# EasyEDA Pro project F4_Camera.eprj (continued)
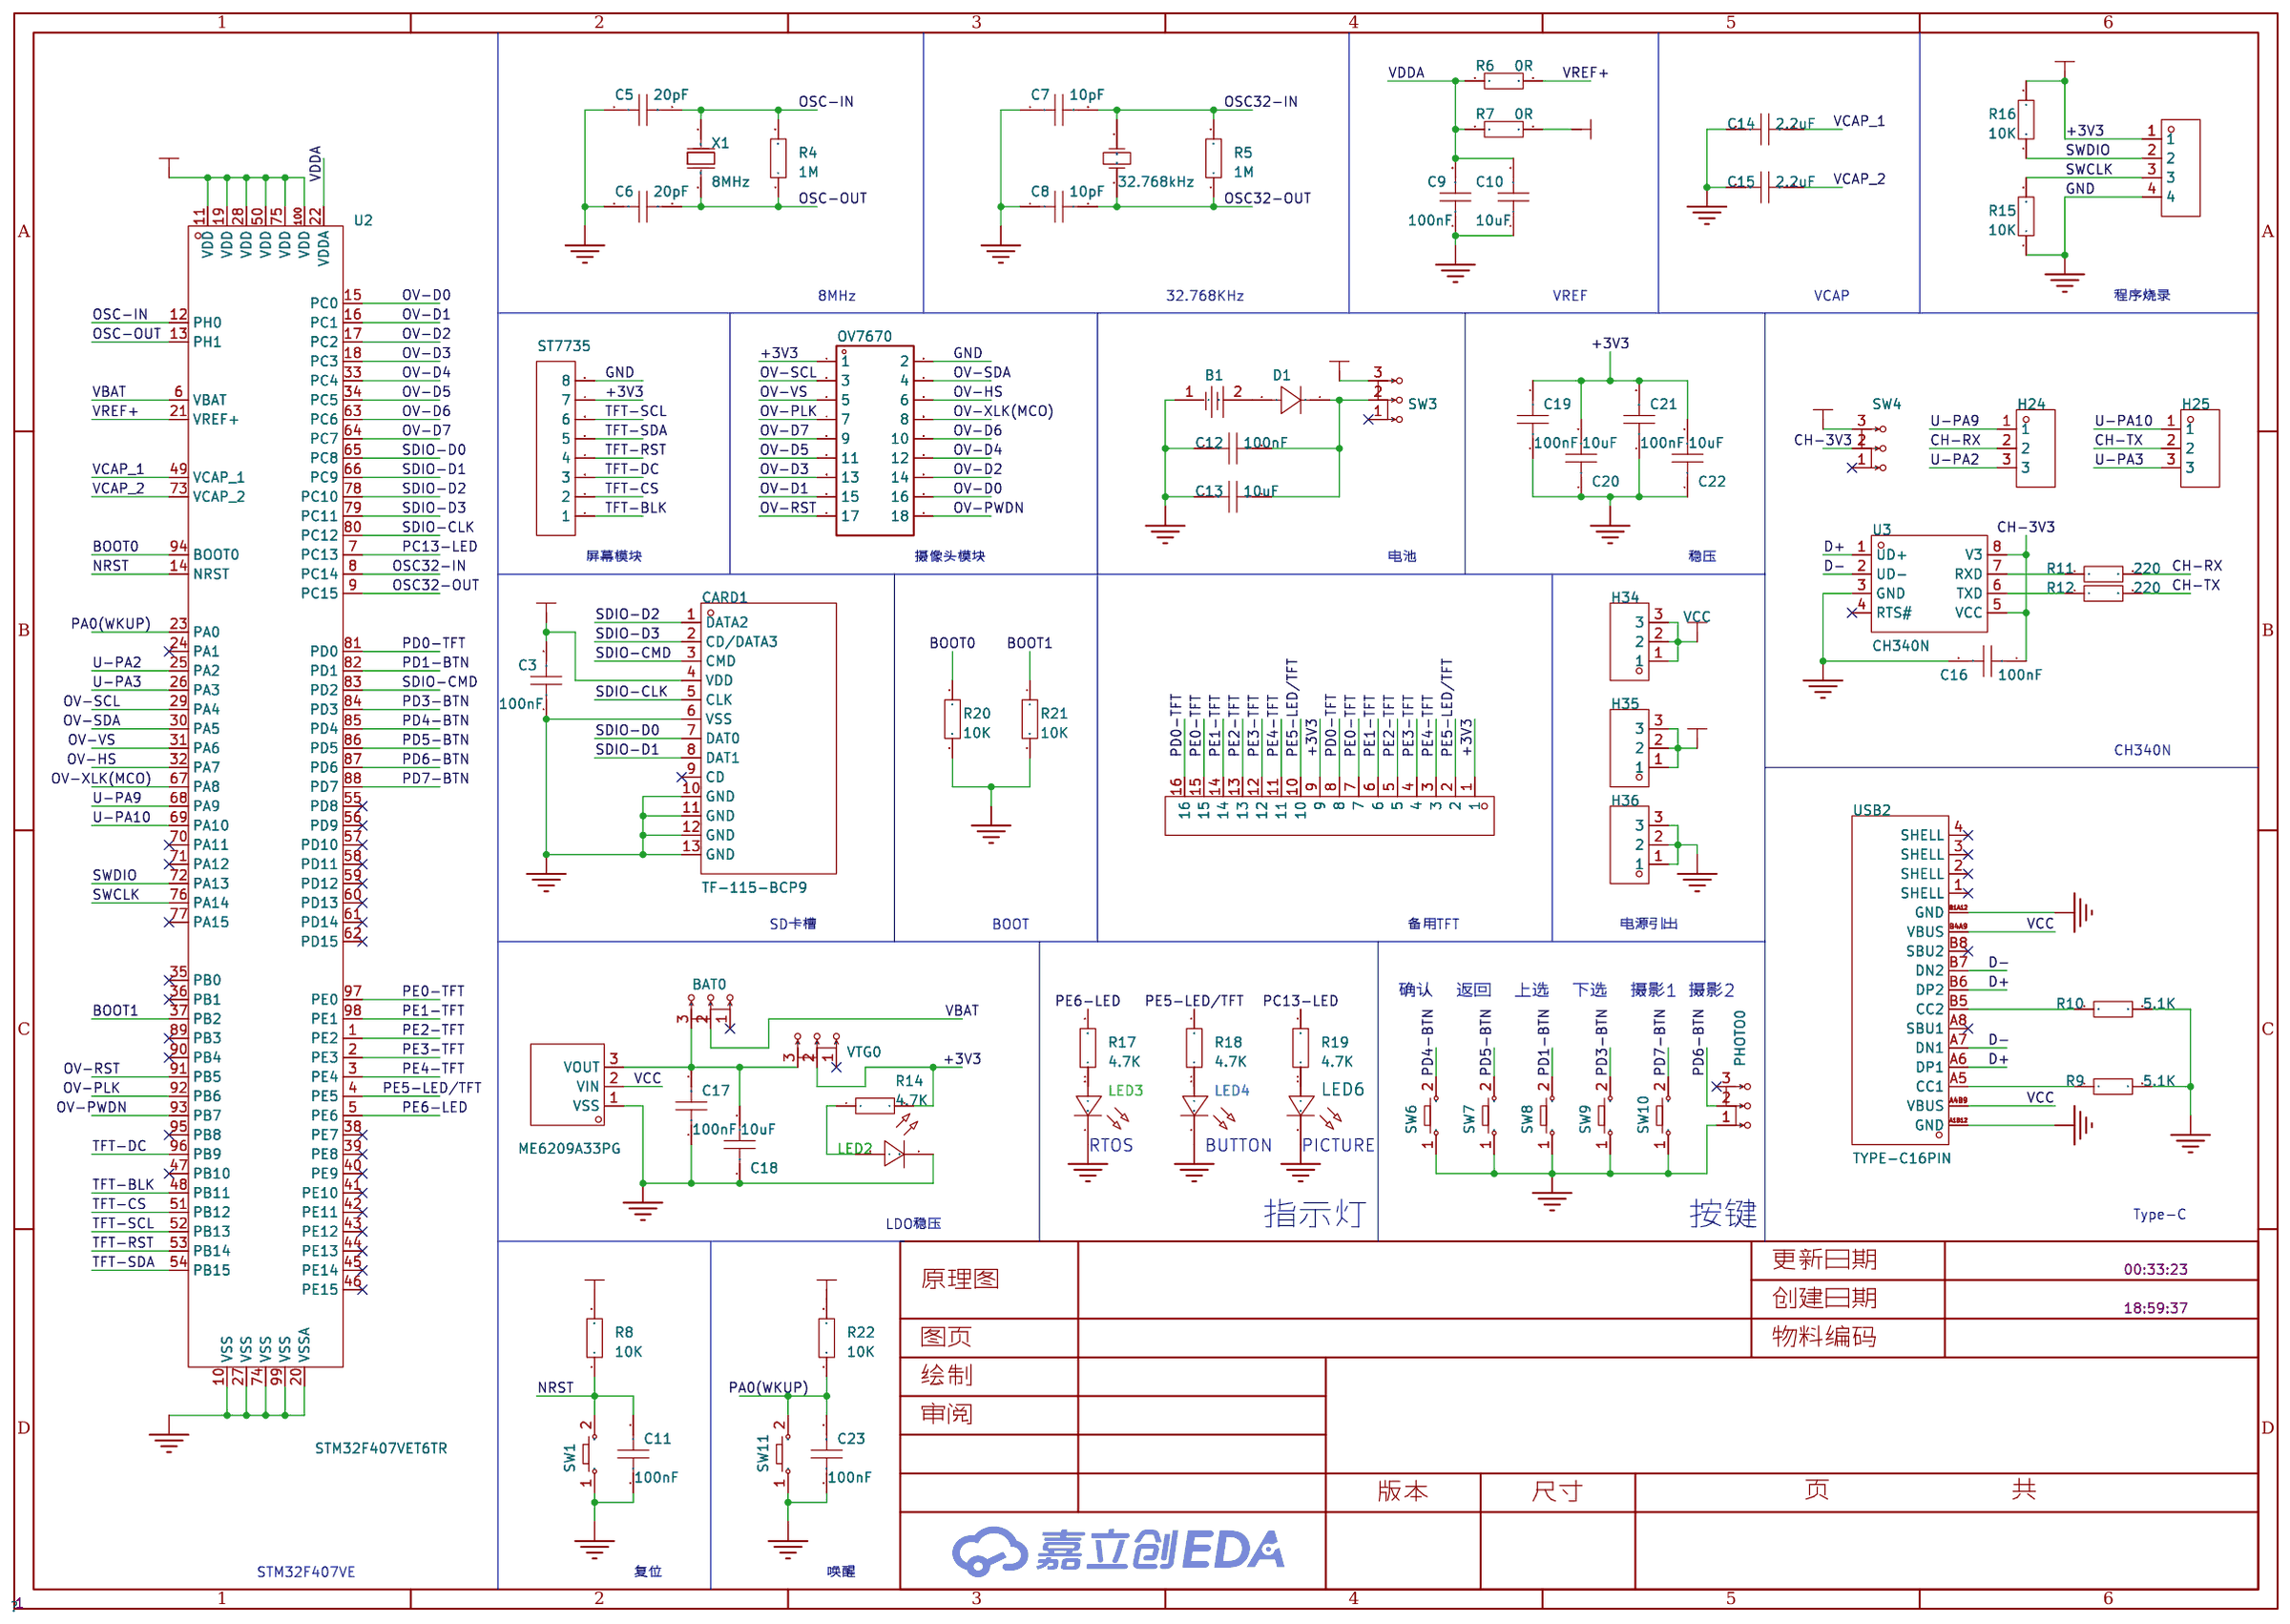
[diagram p0: schematic sheet]
## Placement (name value [footprint] x y rotation side)
B1  BS-02-A1AJ010  [BAT-TH_BS-02-A1AJ010]  63.63 31.34 90 bottom
BAT0  SS-12D01-G5  [SW-TH_SS-12D01-GX]  31.63 58.93 90 top
C3  100nF  [C0805]  16.76 17.22 90 top
C5  20pF  [C0805]  33.21 17.5 0 top
C6  20pF  [C0805]  40.02 17.5 180 top
C7  10pF  [C0805]  21.39 17.22 90 top
C8  10pF  [C0805]  28.65 17.22 90 top
C9  100nF  [C0805]  46.9 16.31 0 top
C10  10uF  [C0805]  46.9 13 0 top
C11  100nF  [C0805]  70.99 13.08 180 top
C12  100nF  [C0805]  68.58 45.66 180 top
C13  10uF  [C0805]  68.58 48.87 180 top
C14  2.2uF  [C0805]  47.03 40.49 90 top
C15  2.2uF  [C0805]  24.21 40.33 270 top
C16  100nF  [C0805]  3.41 50.38 90 top
C17  100nF  [C0805]  15.69 56.12 90 top
C18  10uF  [C0805]  18.95 56.12 90 top
C19  100nF  [C0805]  20.58 32.57 180 top
C20  10uF  [C0805]  15.4 36.12 180 top
C21  100nF  [C0805]  20.58 36.12 180 top
C22  10uF  [C0805]  15.4 32.57 180 top
C23  100nF  [C0805]  59.44 13.08 180 top
CARD1  TF-115-BCP9  [TF-SMD_TF-115-BCP9]  6.86 18.39 270 top
D1  -  [SMA_1N4007]  63.51 48.45 270 top
H24  -  [HDR-TH_3P-P2.54-V-M]  19.75 43.43 90 top
H25  -  [HDR-TH_3P-P2.54-V-M]  15.68 43.43 90 top
H34  -  [HDR-TH_3P-P2.54-V-M]  43.13 59.4 90 top
H35  -  [HDR-TH_3P-P2.54-V-M]  49.16 59.4 90 top
H36  -  [HDR-TH_3P-P2.54-V-M]  55.2 59.4 90 top
H37  -  [HDR-TH_4P-P2.54-V-M]  4.06 34.01 270 top
H38  -  [HDR-TH_16P-P2.54-V-F]  76.45 29.82 270 top
LED2  -  [LED_0805]  22.18 51.29 90 top
LED3  -  [LED_0805]  58.71 34.73 180 top
LED4  -  [LED_0805]  69.08 34.73 180 top
LED6  -  [LED_0805]  63.9 34.73 180 top
OV7670  -  [HDR-TH_18P-P2.54-V-F-R2-C9-S2.54-1]  37.08 49.25 0 bottom
PHOTO0  SS-12D01-G5  [SW-TH_SS-12D01-GX]  63.58 58.59 90 top
R4  1M  [R0805]  36.61 20.78 180 top
R5  1M  [R0805]  25.02 21.19 180 top
R6  0R  [R0805]  46.78 22.55 180 top
R7  0R  [R0805]  46.77 19.5 180 top
R8  10K  [R0805]  70.85 17.09 0 top
R9  5.1K  [R0805]  11.91 60.39 90 top
R10  5.1K  [R0805]  11.91 56.14 270 top
R11  220  [R0805]  18.97 51.13 270 top
R12  220  [R0805]  15.71 51.13 270 top
R14  4.7K  [R0805]  22.11 56.07 90 top
R15  10K  [R0805]  9.57 30.92 90 top
R16  10K  [R0805]  9.57 37.11 90 top
R17  4.7K  [R0805]  58.59 37.9 0 top
R18  4.7K  [R0805]  68.96 37.9 0 top
R19  4.7K  [R0805]  63.78 37.9 0 top
R20  10K  [R0805]  20.72 29.12 180 top
R21  10K  [R0805]  47.04 34.55 90 top
R22  10K  [R0805]  59.3 17.09 0 top
ST7735  -  [HDR-TH_8P-P2.54-V-F-1]  50.8 32.23 90 top
SW1  -  [Key_SMD_3x4x2]  66.41 14.98 90 top
SW3  SS-12D01-G5  [SW-TH_SS-12D01-GX]  37.47 58.93 90 top
SW4  SS-12D01-G5  [SW-TH_SS-12D01-GX]  7.22 43.47 0 top
SW6  -  [Key_SMD_3x4x2]  59.44 30.2 0 top
SW7  -  [Key_SMD_3x4x2]  59.44 24.61 0 top
SW8  -  [Key_SMD_3x4x2]  68.33 30.2 0 top
SW9  -  [Key_SMD_3x4x2]  68.33 24.61 0 top
SW10  -  [Key_SMD_3x4x2]  69.17 60 90 top
SW11  -  [Key_SMD_3x4x2]  54.6 14.98 90 top
U2  STM32F407VET6TR  [LQFP-100_L14.0-W14.0-P0.50-LS16.0-BL]  34.93 34.01 0 top
U3  CH340N  [SOP-8_L4.9-W3.9-P1.27-LS6.0-BL]  9.27 50.39 270 top
U4  ME6209A33PG  [SOT-89-3_L4.5-W2.5-P1.50-LS4.2-BR]  17.37 61.01 270 top
USB2  TYPE-C16PIN  [USB-C-SMD_TYPE-C16PIN]  4.19 58.9 270 top
VTG0  SS-12D01-G5  [SW-TH_SS-12D01-GX]  25.79 58.93 90 top
X1  8MHz  [CRYSTAL-SMD_L11.5-W4.8-LS12.7]  36.62 12.3 0 top
X3  32.768kHz  [OSC-TH_BD3.1-P0.8-D0.3]  25.15 18.39 90 top

## Footprints (pads in the part's own frame, mm; a bottom-side part is the same pattern mirrored in y, then rotated)
BAT-TH_BS-02-A1AJ010
  round 1.8 hole 1.2: 1(-10,0) 2(10,0)
C0805
  rect 1.41x1.35 smd: 1(-1,0) 2(1,0)
CRYSTAL-SMD_L11.5-W4.8-LS12.7
  rect 5.5x2 smd: 1(-4.45,0) 2(4.45,0)
HDR-TH_3P-P2.54-V-M
  rect 1.7x1.7 hole 1.1: 1(-2.54,0)
  round 1.7 hole 1.1: 2(0,0) 3(2.54,0)
HDR-TH_4P-P2.54-V-M
  rect 1.7x1.7 hole 1.1: 1(-3.81,0)
  round 1.7 hole 1.1: 2(-1.27,0) 3(1.27,0) 4(3.81,0)
HDR-TH_8P-P2.54-V-F-1
  rect 1.8x1.8 hole 1.2: 1(-8.89,0)
  round 1.8 hole 1.2: 2(-6.35,0) 3(-3.81,0) 4(-1.27,0) 5(1.27,0) 6(3.81,0) 7(6.35,0) 8(8.89,0)
HDR-TH_16P-P2.54-V-F
  rect 1.6x1.6 hole 1: 1(-19.05,0)
  round 1.6 hole 1: 2(-16.51,0) 3(-13.97,0) 4(-11.43,0) 5(-8.89,0) 6(-6.35,0) 7(-3.81,0) 8(-1.27,0) 9(1.27,0) 10(3.81,0) 11(6.35,0) 12(8.89,0) 13(11.43,0) 14(13.97,0) 15(16.51,0) 16(19.05,0)
HDR-TH_18P-P2.54-V-F-R2-C9-S2.54-1
  rect 1.7x1.7 hole 1.1: 1(-10.16,-1.27)
  round 1.7 hole 1.1: 2(-10.16,1.27) 3(-7.62,-1.27) 4(-7.62,1.27) 5(-5.08,-1.27) 6(-5.08,1.27) 7(-2.54,-1.27) 8(-2.54,1.27) 9(0,-1.27) 10(0,1.27) 11(2.54,-1.27) 12(2.54,1.27) 13(5.08,-1.27) 14(5.08,1.27) 15(7.62,-1.27) 16(7.62,1.27) 17(10.16,-1.27) 18(10.16,1.27)
Key_SMD_3x4x2
  rect 1.53x1.36 smd: 1(-2.035,0) 2(2.035,0)
LED_0805
  rect 1x1.25 smd: 1(-1.15,0.005) 2(1.05,0.005)
LQFP-100_L14.0-W14.0-P0.50-LS16.0-BL
  oval 0.3x1.6 smd: 1(-6,-7.55) 2(-5.5,-7.55) 3(-5,-7.55) 4(-4.5,-7.55) 5(-4,-7.55) 6(-3.5,-7.55) 7(-3,-7.55) 8(-2.5,-7.55) 9(-2,-7.55) 10(-1.5,-7.55) 11(-1,-7.55) 12(-0.5,-7.55) 13(0,-7.55) 14(0.5,-7.55) 15(1,-7.55) 16(1.5,-7.55) 17(2,-7.55) 18(2.5,-7.55) 19(3,-7.55) 20(3.5,-7.55) 21(4,-7.55) 22(4.5,-7.55) 23(5,-7.55) 24(5.5,-7.55) 25(6,-7.55) 51(6,7.55) 52(5.5,7.55) 53(5,7.55) 54(4.5,7.55) 55(4,7.55) 56(3.5,7.55) 57(3,7.55) 58(2.5,7.55) 59(2,7.55) 60(1.5,7.55) 61(1,7.55) 62(0.5,7.55) 63(0,7.55) 64(-0.5,7.55) 65(-1,7.55) 66(-1.5,7.55) 67(-2,7.55) 68(-2.5,7.55) 69(-3,7.55) 70(-3.5,7.55) 71(-4,7.55) 72(-4.5,7.55) 73(-5,7.55) 74(-5.5,7.55) 75(-6,7.55)
  oval 1.6x0.3 smd: 26(7.55,-6) 27(7.55,-5.5) 28(7.55,-5) 29(7.55,-4.5) 30(7.55,-4) 31(7.55,-3.5) 32(7.55,-3) 33(7.55,-2.5) 34(7.55,-2) 35(7.55,-1.5) 36(7.55,-1) 37(7.55,-0.5) 38(7.55,0) 39(7.55,0.5) 40(7.55,1) 41(7.55,1.5) 42(7.55,2) 43(7.55,2.5) 44(7.55,3) 45(7.55,3.5) 46(7.55,4) 47(7.55,4.5) 48(7.55,5) 49(7.55,5.5) 50(7.55,6) 76(-7.55,6) 77(-7.55,5.5) 78(-7.55,5) 79(-7.55,4.5) 80(-7.55,4) 81(-7.55,3.5) 82(-7.55,3) 83(-7.55,2.5) 84(-7.55,2) 85(-7.55,1.5) 86(-7.55,1) 87(-7.55,0.5) 88(-7.55,0) 89(-7.55,-0.5) 90(-7.55,-1) 91(-7.55,-1.5) 92(-7.55,-2) 93(-7.55,-2.5) 94(-7.55,-3) 95(-7.55,-3.5) 96(-7.55,-4) 97(-7.55,-4.5) 98(-7.55,-5) 99(-7.55,-5.5) 100(-7.55,-6)
OSC-TH_BD3.1-P0.8-D0.3
  round 1.2 hole 0.8: 1(0,0.8) 2(0,-0.8)
R0805
  rect 1.133x1.377 smd: 1(-1,0) 2(1,0)
SMA_1N4007
  rect 2.046x1.62 smd: 1(-2.566,0) 2(2.566,0)
SOP-8_L4.9-W3.9-P1.27-LS6.0-BL
  oval 0.63x1.865 smd: 1(-1.905,-2.683) 2(-0.635,-2.683) 3(0.635,-2.683) 4(1.905,-2.683) 5(1.905,2.683) 6(0.635,2.683) 7(-0.635,2.683) 8(-1.905,2.683)
SOT-89-3_L4.5-W2.5-P1.50-LS4.2-BR
  rect 1.575x0.672 smd: 1(1.356,-1.5) 3(1.356,1.5)
  custom 0x0 smd: 2(-1.356,0)
SW-TH_SS-12D01-GX
  round 1.524 hole 0.914: 1(-2.5,0) 2(0,0) 3(2.5,0)
TF-SMD_TF-115-BCP9
  rect 0.7x1.6 smd: 1(2.25,5.3) 2(1.15,5.3) 3(0.05,5.3) 4(-1.05,5.3) 5(-2.15,5.3) 6(-3.25,5.3) 7(-4.35,5.3) 8(-5.45,5.3) 9(-6.55,5.3)
  rect 1.2x1.5 smd: 10(-7.75,4.3)
  rect 1.2x2.2 smd: 11(-7.75,-5.3) 13(7.75,-5.3)
  rect 1.6x1.5 smd: 12(6.85,4.3)
USB-C-SMD_TYPE-C16PIN
  oval 1x2.1 hole 0.6x1.7: 1(-4.32,1.788) 2(4.32,1.788)
  oval 1x1.8 hole 0.6x1.4: 3(-4.32,-2.362) 4(4.32,-2.362)
  rect 0.6x1.15 smd: A1B12(-3.2,2.362) A4B9(-2.4,2.362) B1A12(3.2,2.362) B4A9(2.4,2.362)
  rect 0.3x1.15 smd: A5(-1.25,2.362) A6(-0.25,2.362) A7(0.25,2.362) A8(1.25,2.362) B5(1.75,2.362) B6(0.75,2.362) B7(-0.75,2.362) B8(-1.75,2.362)

## Nets
As in the schematic.

Pads without a net: BAT0 1; CARD1 9; PHOTO0 3; SW3 1; SW4 1; U2 24 35 36 38 39 40 41 42 43 44 45 46 47 55 56 57 58 59 60 61 62 70 71 77 89 90 95; U3 4; USB2 1 2 3 4 A8 B8; VTG0 1

## Via types
v1: diameter 4.572, hole 3.556, Top Layer to Bottom Layer, 3 vias
v2: diameter 0.61, hole 0.305, Top Layer to Bottom Layer, 221 vias

## Routing (per net, layer and track width the routed paths; a pad name or vN(x,y) marks a point on that pad's centre or on a via; arc(x,y) is an arc through that point)
+3V3: length 382.9
  Top Layer w0.254: U2.11 33.93,23.36 v2(33.66,23.09) ; U2.50 44.99,40.01 v2(45.21,40.23) ; H38.9 v2(72.01,28.55)
  Top Layer w0.305: R16.2 9.72,38.26 SW4.3 ; v2(26.23,26.33) 27.38,27.48 U2.100 ; 61.95,11.28 73.53,11.28 74.04,11.79 74.04,16.61 73.53,17.12 71.88,17.12 R8.2 ; 61.95,11.28 61.98,11.3 61.98,16.61 61.5,17.09 R22.2 ; 61.95,11.28 50.8,11.28 50.16,11.91 v2(50.16,15.22) ; 19.64,37.69 19.58,37.64 C21.2 ; R7.2 45.73,19.53 v2(41.66,19.53) ; v2(37.08,23.98) 37.59,23.98 37.93,24.31 U2.19 37.93,28.38 38.56,29.01 U2.28 ; v2(18.03,33.63) 18.03,32.74 18.29,32.49 19.5,32.49 C19.2
  Top Layer w0.355: C19.2 19.56,32.6 19.56,36.1 C21.2 ; OV7670.1 26.8,50.39 v2(24.26,50.39) 24.26,58.89 24.27,58.9 ; 24.27,58.9 25.77,58.9 VTG0.2 ; 24.27,58.9 22.73,58.9 22.11,58.28 R14.2 ; 14.35,19.44 16.48,19.44 16.76,19.15 C3.2 ; 14.35,19.44 14.35,28.17 ; 14.35,19.44 CARD1.4 ; U2.75 28.09,42.39 v2(25.65,42.39) 25.65,38.58 24.76,37.69 14.73,37.69 14.4,37.37 C20.2 C22.2 14.35,32.52 14.35,28.17 ; 14.35,28.17 2.54,28.17 1.78,28.93 1.78,37.06 2.54,37.82 H37.1 4.35,38.11 R16.2
  Top Layer w0.508: H35.1 H35.2 H35.3
  Bottom Layer w0.305: v2(33.66,23.09) 36.19,23.09 v2(37.08,23.98) 40.51,23.98 41.66,22.84 v2(41.66,19.53) 41.66,17.25 43.69,15.22 v2(50.16,15.22) ; 72.01,48.88 72.01,62.46 71.12,63.35 50.57,63.35 H35.3 ; 72.01,48.88 v2(72.01,28.55) ; 72.01,48.88 72.02,48.87 H38.1 ; ST7735.7 53.72,38.58 54.48,39.35 54.48,54.33 53.72,55.09 49.78,55.09 49.15,55.73 49.15,56.85 ; v2(45.21,40.23) 45.85,40.23 46.23,39.85 46.23,33.76 45.72,33.25 18.41,33.25 v2(18.03,33.63)
  Bottom Layer w0.355: v2(14.36,26.34) 14.41,26.39 26.16,26.39 v2(26.23,26.33) 27.31,27.41 31.88,27.41 33.66,25.63 v2(33.66,23.09) ; v2(25.65,42.39) 24.26,43.79 v2(24.26,50.39) ; H35.1 49.15,56.85 47.6,56.85 45.34,54.59 28.83,54.59 28.07,55.35 28.07,58.27 27.41,58.93 VTG0.2
GND: length 29.6
  Top Layer w0.254: U2.10 33.43,27.94 v2(32.44,28.93) 31.37,28.93 30.48,28.04 29.08,28.04 28.61,28.51 U2.99 ; U2.74 29.43,40.53 29.97,39.98 30.86,39.98 33.91,36.93 33.91,34.58 v2(34.54,33.95) ; U2.20 38.43,27.99 38.95,28.51 U2.27
  Top Layer w0.508: H36.3 H36.2 H36.1
  vias: v2(3.68,21.06) v2(3.68,18.84) v2(3.68,16.61) v2(4.06,40.36) v2(4.7,46.2) v2(4.95,57) v2(6.22,40.36) v2(8.38,40.36) v2(9.8,46.2) v2(10.54,40.36) v2(10.67,33.25) v2(12.83,27.15) v2(13.46,34.27) v2(13.59,7.72) v2(13.59,6.45) v2(13.59,5.18) v2(13.84,40.87) v2(16.38,34.27) v2(17.65,29.82) v2(17.78,40.87) v2(21.08,59.92) v2(21.34,34.14) v2(21.97,59.92) v2(22.61,47.86) v2(22.61,46.53) v2(22.86,59.92) v2(22.86,19.66) v2(23.65,16.39) v2(23.65,14.39) v2(23.65,12.39) v2(23.65,10.39) v2(23.65,8.39) v2(25.15,8.39) v2(26.54,41.63) v2(26.65,16.39) v2(26.65,14.39) v2(26.65,12.39) v2(26.65,10.39) v2(26.65,8.39) v2(30.1,34.27) v2(30.92,14.7) v2(30.92,9.9) v2(31.88,22.07) v2(32.3,15.59) v2(33.15,19.41) v2(33.2,9.9) v2(33.66,43.54) v2(34.54,59.92) v2(34.54,58.84) v2(34.54,57.76) v2(35.48,9.9) v2(37.76,9.9) v2(38.48,46.08) v2(40,19.53) v2(40.04,9.9) v2(40.64,59.92) v2(40.64,58.84) v2(40.64,57.76) v2(40.96,15.59) v2(41.91,42.78) v2(42.32,14.7) v2(42.32,9.9) v2(42.54,23.22) v2(43.31,26.27) v2(44.2,38.08) v2(45.72,25.76) v2(45.85,10.01) v2(46.23,59.92) v2(46.23,58.83) v2(46.23,57.75) v2(46.86,25.76) v2(47.18,10.01) v2(48.01,25.76) v2(48.51,10.01) v2(50.8,20.55) v2(51.05,45.95) v2(52.37,20.55) v2(53.59,44.05) v2(53.95,20.55) v2(56.26,51.67) v2(56.26,50.01) v2(56.26,48.36) v2(56.26,46.71) v2(60.32,49.25) v2(60.32,47.35) v2(60.32,45.44) v2(64.01,30.43) v2(64.01,28.84) v2(64.01,27.24) v2(68.58,43.28) v2(68.58,42.01) v2(69.22,55.35) v2(69.22,53.63) v2(69.22,51.92) v2(69.98,42.01) v2(76.45,55.35) v2(76.45,53.63) v2(76.45,51.92)
VBAT: length 77.1
  Top Layer w0.305: v2(31.88,28.3) 31.43,27.84 U2.6 ; v2(12.83,29.06) 12.76,29.12 12.76,44.87 v2(12.7,44.93)
  Bottom Layer w0.305: v2(12.83,29.06) 13.72,28.17 31.75,28.17 v2(31.88,28.3) ; v2(12.7,44.93) 12.7,61.83 13.72,62.84 28.96,62.84 29.72,62.08 29.72,59.16 30.07,58.81 31.51,58.81 BAT0.2
VCC: length 56.1
  Top Layer w0.508: USB2.B4A9 8.88,56.5 v2(9.4,55.98) ; 37.59,63.48 37.47,63.36 SW3.3 ; 37.59,63.48 20.7,63.48 19.59,62.37 17.37,62.37 16.64,63.09 v2(9.46,63.09) 7.67,61.3 USB2.A4B9 ; 37.59,63.48 41.6,63.48 H34.3 H34.2 H34.1
  Bottom Layer w0.508: v2(9.46,63.09) 9.4,63.03 v2(9.4,55.98)
VDDA: length 21.3
  Top Layer w0.254: U2.22 39.43,24.56 40.13,23.85 47.5,23.85 47.75,23.6 47.75,22.58 R6.1 47.78,19.52 R7.1 47.77,16.45 C9.2 C10.2
(no net):
  vias: v1(3.5,3.5) v1(81.5,61.5) v1(81.5,3.5)
BOOT0: length 11.4
  Top Layer w0.254: v2(29.84,30.71) 29.54,31.01 U2.94 ; R20.1 22.79,29.12 v2(23.5,29.82)
  Bottom Layer w0.254: v2(23.5,29.82) 24.38,30.71 v2(29.84,30.71)
BOOT1: length 4.3
  Top Layer w0.254: 46.78,33.55 46.75,33.51 U2.37
CH-3V3: length 21.2
  Top Layer w0.254: U3.8 10.92,52.3 10.54,51.92 10.54,48.87 10.92,48.49 U3.5 11.95,47.87 11.3,47.22 7.22,47.22 ; 7.22,47.22 7.22,47.22 SW4.2 ; 7.22,47.22 3.94,47.22 3.43,47.73 3.43,49.37 C16.1
CH-RX: length 8.3
  Top Layer w0.254: H24.2 19.72,43.41 18.54,43.41 18.29,43.66 18.29,48.49 18.97,49.17 R11.2
CH-TX: length 8.7
  Top Layer w0.254: H25.2 15.66,43.41 14.48,43.41 14.22,43.66 14.22,48.24 15.71,49.72 R12.2
D+: length 13
  Top Layer w0.254: USB2.A6 7.5,59.15 7.75,58.9 7.75,58.4 7.49,58.14 6.57,58.14 USB2.B6 6.54,58.14 4.57,58.14 4.06,57.63 4.06,54.2 4.83,53.44 6.1,53.44 6.6,52.94 6.6,52.32 U3.1
D-: length 15.1
  Top Layer w0.254: 5.38,59.67 6.54,59.67 USB2.B7 ; 5.38,59.67 5.38,58.86 5.59,58.65 6.55,58.65 USB2.A7 ; 5.38,59.67 4.7,59.67 3.56,58.52 3.56,53.7 4.88,52.37 4.88,51.36 5.21,51.03 U3.2
NRST: length 50.4
  Top Layer w0.254: v2(42.54,21.31) 39.62,21.31 37.59,23.34 36.19,23.34 35.43,24.11 U2.14 ; v2(51.56,16.99) 51.56,18.52 52.2,19.15 65.79,19.15 66.42,18.52 66.42,17.03 SW1.2 69.78,17.02 R8.1 69.85,13.21 C11.2
  Bottom Layer w0.254: v2(51.56,16.99) 50.67,16.11 43.94,16.11 42.54,17.5 v2(42.54,21.31)
OSC32-IN: length 19
  Top Layer w0.254: U2.8 32.43,23.89 31.75,23.22 24.51,23.22 24.02,22.72 R5.2 24.02,18.72 X3.1 21.57,18.39 C7.2
OSC32-OUT: length 19
  Top Layer w0.254: U2.9 32.93,20.96 32.51,20.55 31.37,20.55 30.73,21.19 29.72,21.19 29.08,20.55 28.07,20.55 27.43,21.19 R5.1 26.02,18.46 X3.2 28.48,18.39 C8.2
OSC-IN: length 18.4
  Top Layer w0.254: X1.1 34.21,14.34 C5.2 34.34,17.38 35.31,17.38 35.61,17.68 R4.2 35.45,20.62 34.16,20.62 33.91,20.88 33.91,22.2 34.43,22.72 U2.12
OSC-OUT: length 18.4
  Top Layer w0.254: 38.99,17.47 38.99,14.38 X1.2 ; 38.99,17.47 C6.2 ; 38.99,17.47 38.89,17.38 37.85,17.38 37.61,17.61 R4.1 37.59,20.8 37.59,22.2 36.96,22.84 35.55,22.84 34.93,23.46 U2.13
OV-D0: length 37.9
  Top Layer w0.254: U2.15 35.93,27.88 v2(34.8,29.01)
  Bottom Layer w0.254: v2(34.8,29.01) 35.38,28.42 46.48,28.42 48.13,30.08 48.13,43.03 47.62,43.54 45.34,43.54 44.7,44.17 OV7670.16
OV-D1: length 54.8
  Top Layer w0.254: v2(50.29,52.43) 44.96,52.43 44.7,52.17 OV7670.15 ; v2(33.27,29.49) 33.38,29.59 35.22,29.59 36.43,28.38 U2.16
  Bottom Layer w0.254: v2(33.27,29.49) 33.27,28.3 34.16,27.41 47.37,27.41 49.15,29.19 49.15,43.79 50.29,44.93 v2(50.29,52.43)
OV-D2: length 40.2
  Top Layer w0.254: U2.17 36.93,28.76 v2(35.31,30.38)
  Bottom Layer w0.254: v2(35.31,30.38) 35.31,29.69 36.07,28.93 46.23,28.93 47.62,30.33 47.62,42.21 46.93,42.9 43.81,42.9 42.16,44.55 OV7670.14
OV-D3: length 57.7
  Top Layer w0.254: U2.18 37.43,28.97 36.45,29.95 36.45,30.46 35.94,30.96 34.62,30.96 v2(34.04,30.38)
  Bottom Layer w0.254: OV7670.13 42.16,52.94 42.54,53.32 47.88,53.32 49.4,51.79 49.4,44.81 48.64,44.05 48.64,29.57 46.99,27.92 34.54,27.92 34.04,28.42 v2(34.04,30.38)
OV-D4: length 19
  Top Layer w0.254: U2.33 40.22,31.51 39.65,32.08 v2(39.65,37.98)
  Bottom Layer w0.254: v2(39.65,37.98) 39.62,38.01 OV7670.12
OV-D5: length 52.8
  Top Layer w0.254: v2(53.34,53.95) 53.34,45.06 52.2,43.92 40.64,43.92 v2(40.26,43.54) ; U2.34 40.86,32.01 40.26,32.61 v2(40.26,38.49)
  Bottom Layer w0.254: v2(40.26,38.49) v2(40.26,43.54) ; v2(53.34,53.95) 40.13,53.95 39.62,53.44 OV7670.11
OV-D6: length 8
  Top Layer w0.254: U2.63 34.93,44.93 35.94,45.95 v2(37.08,45.95)
  Bottom Layer w0.254: v2(37.08,45.95) OV7670.10
OV-D7: length 43.2
  Top Layer w0.254: OV7670.9 37.08,52.55 37.59,53.06 50.67,53.06 51.18,52.55 51.18,47.22 50.67,46.71 35.81,46.71 34.43,45.32 U2.64
OV-HS: length 26.4
  Top Layer w0.254: U2.32 39.7,31.01 38.99,31.73 v2(38.99,37.44)
  Bottom Layer w0.254: OV7670.6 32,45.7 32.38,45.31 38.23,45.31 38.99,44.55 v2(38.99,37.44)
OV-PLK: length 42.5
  Top Layer w0.254: v2(32,37.19) 32,32.49 31.53,32.01 U2.92
  Bottom Layer w0.254: v2(32,37.19) 32,42.39 31.12,43.28 27.18,43.28 25.4,45.06 25.4,52.94 26.16,53.7 33.78,53.7 34.54,52.94 OV7670.7
OV-PWDN: length 48.6
  Top Layer w0.254: v2(31.62,30.71) 30.82,31.51 U2.93 ; v2(41.15,46.08) 41.15,46.07 47.24,46.07 v2(47.24,46.08)
  Bottom Layer w0.254: v2(41.15,46.08) 41.15,44.68 43.56,42.27 46.23,42.27 46.99,41.5 46.99,30.71 45.85,29.57 37.59,29.57 36.07,31.09 32,31.09 v2(31.62,30.71) ; v2(47.24,46.08) OV7670.18
OV-RST: length 37.9
  Top Layer w0.254: U2.91 30.88,32.51 31.24,32.87 v2(31.24,34.27) ; v2(35.56,43.54) 37.52,45.49 48.56,45.49 v2(48.64,45.57)
  Bottom Layer w0.254: v2(35.56,43.54) 35.56,39.35 34.29,38.08 34.29,35.03 33.53,34.27 v2(31.24,34.27) ; v2(48.64,45.57) 48.64,50.27 48.39,50.52 OV7670.17
OV-SCL: length 67.2
  Top Layer w0.254: v2(33.22,52.81) 33.83,53.42 50.82,53.42 51.43,52.81 51.82,52.81 51.94,52.94 51.94,45.7 51.23,44.98 38.33,44.98 v2(36.88,43.54) ; U2.29 37.77,29.51 36.96,30.33 v2(36.96,35.92)
  Bottom Layer w0.254: v2(36.88,43.54) 36.88,35.99 v2(36.96,35.92) ; v2(33.22,52.81) 30.23,52.81 29.46,52.05 OV7670.3
OV-SDA: length 30
  Top Layer w0.254: U2.30 38.29,30.01 37.6,30.71 v2(37.6,36.45)
  Bottom Layer w0.254: v2(37.6,36.45) 37.6,44.17 36.96,44.81 29.84,44.81 29.46,45.19 OV7670.4
OV-VS: length 64.2
  Top Layer w0.254: U2.31 38.93,30.51 38.33,31.11 v2(38.33,36.91) ; OV7670.5 32,53.57 32.59,54.15 51.87,54.15 52.58,53.44 52.58,45.31 51.69,44.43 38.99,44.43 38.35,43.79 v2(38.35,43.54)
  Bottom Layer w0.254: v2(38.35,43.54) 38.33,43.51 v2(38.33,36.91)
OV-XLK(MCO): length 7.1
  Top Layer w0.254: OV7670.8 34.54,46.58 32.93,44.97 U2.67
PA0(WKUP): length 33
  Top Layer w0.254: U2.23 39.93,25.08 40.44,24.56 v2(43.31,24.56) ; C23.2 58.3,13.22 R22.1 58.22,17.02 SW11.2 54.61,17.01 54.61,16.11 54.23,15.72 51.18,15.72 50.16,16.74 v2(50.16,16.99)
  Bottom Layer w0.254: v2(43.31,24.56) 43.31,17.76 44.07,16.99 v2(50.16,16.99)
PC13-LED: length 91.3
  Top Layer w0.254: v2(56.26,40.62) 59.44,40.62 60.83,39.22 64.52,39.22 64.77,38.97 64.77,37.91 R19.2 ; v2(30.35,23.85) 31.37,23.85 31.93,24.41 U2.7
  Bottom Layer w0.254: v2(56.26,40.62) 56.26,9.5 54.86,8.1 28.96,8.1 27.69,9.37 27.69,20.93 28.32,21.57 29.72,21.57 30.35,22.2 v2(30.35,23.85)
PD0-TFT: length 133.7
  Top Layer w0.254: H38.8 76.2,30.84 v2(72.9,30.84) ; v2(15.11,25.38) 15.11,30.58 16,31.47 22.35,31.47 22.86,31.98 22.86,35.54 24.38,37.06 25.15,37.06 25.6,37.51 U2.81 ; v2(15.11,5.18) 15.19,5.1 v2(73.53,5.1)
  Bottom Layer w0.254: v2(72.9,30.84) 72.9,11.41 73.53,10.77 ; 73.53,10.77 H38.16 ; 73.53,10.77 v2(73.53,5.1) ; v2(15.11,25.38) v2(15.11,5.18)
PD1-BTN: length 124
  Top Layer w0.254: SW8.2 70.36,30.2 v2(70.36,27.41) ; U2.82 25.86,37.01 25.4,36.55 24.64,36.55 23.37,35.28 23.37,31.6 22.73,30.96 16.51,30.96 15.75,30.2 v2(15.75,24.61)
  Bottom Layer w0.254: v2(70.36,27.41) 70.36,4.42 68.96,3.02 17.02,3.02 15.75,4.29 v2(15.75,24.61)
PD3-BTN: length 114.8
  Top Layer w0.254: v2(68.71,21.95) 69.98,21.95 70.36,22.33 70.36,24.61 SW9.2 ; v2(16.38,23.85) 16.38,29.82 17.02,30.46 23.11,30.46 23.88,31.22 23.88,35.03 24.86,36.01 U2.84
  Bottom Layer w0.254: v2(16.38,23.85) 16.38,5.18 17.78,3.79 67.31,3.79 68.71,5.18 v2(68.71,21.95)
PD4-BTN: length 108.4
  Top Layer w0.254: SW6.2 61.47,27.28 v2(61.47,27.28) ; U2.85 25.12,35.51 24.38,34.77 24.38,28.3 23.88,27.79 18.03,27.79 17.02,26.77 v2(17.02,23.22)
  Bottom Layer w0.254: v2(61.47,27.28) 61.47,6.2 59.82,4.55 18.29,4.55 17.02,5.82 v2(17.02,23.22)
PD5-BTN: length 99.1
  Top Layer w0.254: SW7.2 61.47,24.61 61.47,22.58 60.83,21.95 v2(59.69,21.95) ; U2.86 25.64,35.01 24.89,34.27 24.89,27.92 24.26,27.28 18.54,27.28 17.65,26.39 v2(17.65,22.58)
  Bottom Layer w0.254: v2(17.65,22.58) 17.65,6.45 18.8,5.31 57.78,5.31 59.69,7.22 v2(59.69,21.95)
PD6-BTN: length 132
  Top Layer w0.254: U2.87 26.03,34.51 25.4,33.89 25.4,27.53 24.64,26.77 19.18,26.77 18.29,25.88 v2(18.29,21.95)
  Bottom Layer w0.254: PHOTO0.2 63.52,58.52 59.44,58.52 58.8,57.89 58.8,7.85 57.02,6.07 19.18,6.07 18.29,6.96 v2(18.29,21.95)
PD7-BTN: length 139
  Top Layer w0.254: v2(18.92,21.31) 18.92,25.25 19.94,26.27 25.15,26.27 25.91,27.03 25.91,33.5 26.42,34.01 U2.88 ; SW10.2 69.13,62.08 67.06,62.08 66.17,62.97 59.06,62.97 v2(57.91,61.83)
  Bottom Layer w0.254: v2(57.91,61.83) 57.91,8.48 56.26,6.83 19.69,6.83 18.92,7.6 v2(18.92,21.31)
PE0-TFT: length 152.9
  Top Layer w0.254: H38.7 v2(73.66,33.63) ; U2.97 30.3,29.51 30.73,29.95 v2(31.62,29.95) ; H38.15 75.18,13.31 74.8,12.93 v2(74.8,8.1) ; v2(11.18,3.53) v2(74.8,3.53)
  Bottom Layer w0.254: v2(74.8,3.53) v2(74.8,8.1) ; H38.15 74.29,13.31 73.66,13.95 v2(73.66,33.63) ; 31.62,29.95 26.29,29.95 25.53,29.19 15.24,29.19 13.74,30.69 11.91,30.69 11.18,29.95 v2(11.18,3.53)
PE1-TFT: length 154
  Top Layer w0.254: v2(80.9,15.85) 80.9,7.72 77.47,4.29 v2(12.19,4.29) ; 76.45,36.17 v2(74.42,36.17) ; v2(29.97,28.93) 29.89,29.01 U2.98
  Bottom Layer w0.254: v2(12.19,4.29) 11.81,4.68 11.81,29.44 12.45,30.08 13.33,30.08 14.73,28.68 29.72,28.68 v2(29.97,28.93) ; v2(74.42,36.17) 74.42,16.23 74.93,15.72 76.33,15.72 H38.14 v2(80.9,15.85)
PE2-TFT: length 128.3
  Top Layer w0.254: v2(78.87,18.52) 78.87,7.09 77.6,5.82 20.32,5.82 19.56,6.58 v2(19.56,8.36) ; v2(19.56,20.68) 19.56,24.87 20.19,25.5 28.7,25.5 28.93,25.73 U2.1 ; H38.5 v2(80.9,38.71)
  Bottom Layer w0.254: v2(19.56,20.68) v2(19.56,8.36) ; 76.45,18.39 78.74,18.39 v2(78.87,18.52) 80.9,20.55 v2(80.9,38.71)
PE3-TFT: length 126.7
  Top Layer w0.254: H38.4 v2(80.01,41.25) ; v2(78.23,20.93) 78.23,7.72 77.09,6.58 20.83,6.58 20.19,7.22 v2(20.19,9.12) ; U2.2 29.43,25.46 28.96,25 20.7,25 20.19,24.49 v2(20.19,20.04)
  Bottom Layer w0.254: v2(20.19,20.04) v2(20.19,9.12) ; v2(80.01,41.25) 80.01,21.95 78.99,20.93 v2(78.23,20.93) H38.12
PE4-TFT: length 128
  Top Layer w0.254: U2.3 29.93,25.33 29.08,24.49 21.21,24.49 v2(20.96,24.23) ; v2(79.76,8.1) 79.76,23.98 v2(79.25,24.49) ; H38.3 v2(79.25,43.79) ; v2(76.33,8.1) 75.44,7.22 22.1,7.22 v2(20.96,8.36)
  Bottom Layer w0.254: v2(79.25,43.79) v2(79.25,24.49) 78.23,23.47 H38.11 ; v2(76.33,8.1) v2(79.76,8.1) ; v2(20.96,24.23) v2(20.96,8.36)
PE5-LED/TFT: length 148.1
  Top Layer w0.254: v2(78.49,46.33) H38.2 74.17,46.33 73.28,45.44 73.28,38.33 72.85,37.9 R18.2 69.98,37.92 69.98,39.35 69.47,39.85 61.34,39.85 59.56,41.63 v2(57.02,41.63) ; v2(21.72,22.84) 22.48,22.84 23.5,23.85 29.21,23.85 30.43,25.07 U2.4
  Bottom Layer w0.254: v2(78.49,46.33) 78.49,26.65 77.85,26.01 H38.10 ; v2(21.72,22.84) 21.72,8.1 22.35,7.47 55.5,7.47 57.02,8.99 v2(57.02,41.63)
PE6-LED: length 81.6
  Top Layer w0.254: v2(55.47,39.63) 59.15,39.63 59.56,39.22 59.56,37.93 R17.2 ; U2.5 v2(30.93,24.61)
  Bottom Layer w0.254: v2(30.93,24.61) 30.93,24.11 30.94,24.09 30.94,21.9 29.99,20.95 28.98,20.95 28.45,20.42 28.45,9.63 29.34,8.74 54.23,8.74 55.47,9.98 v2(55.47,39.63)
SDIO-CLK: length 48.3
  Top Layer w0.254: v2(7.75,20.55) 7.76,20.54 12.16,20.54 ; U2.80 v2(31.37,38.01)
  Bottom Layer w0.254: v2(31.37,38.01) 30.16,36.81 8.64,36.81 7.75,35.92 v2(7.75,20.55)
SDIO-CMD: length 47.6
  Top Layer w0.254: U2.83 v2(31.12,36.51) ; v2(8.38,18.39) 8.43,18.34 12.16,18.34
  Bottom Layer w0.254: v2(31.12,36.51) 30.77,36.17 9.4,36.17 8.38,35.16 v2(8.38,18.39)
SDIO-D0: length 44.4
  Top Layer w0.254: v2(9.91,22.58) 12,22.58 CARD1.7 ; U2.65 33.93,39.23 v2(33.66,38.97)
  Bottom Layer w0.254: v2(33.66,38.97) 33.66,35.54 33.15,35.03 10.67,35.03 9.91,34.27 v2(9.91,22.58)
SDIO-D1: length 43.7
  Top Layer w0.254: v2(9.14,23.85) 12.15,23.85 12.16,23.84 ; v2(32.79,39.35) 33.4,39.96 33.4,41.54 U2.66
  Bottom Layer w0.254: v2(32.79,39.35) 32.79,36.07 32.26,35.54 10.16,35.54 9.14,34.52 v2(9.14,23.85)
SDIO-D2: length 53.7
  Top Layer w0.254: v2(29.84,39.22) 29.64,39.01 U2.78 ; CARD1.1 12.12,16.11 v2(6.35,16.11)
  Bottom Layer w0.254: v2(29.84,39.22) 28.57,37.95 7.24,37.95 6.35,37.06 v2(6.35,16.11)
SDIO-D3: length 52.2
  Top Layer w0.254: U2.79 30.41,38.51 v2(30.61,38.71) ; v2(7.06,17.25) 7.07,17.24 CARD1.2
  Bottom Layer w0.254: v2(30.61,38.71) 29.34,37.44 7.87,37.44 7.06,36.63 v2(7.06,17.25)
SWCLK: length 36.7
  Top Layer w0.254: R15.2 7.55,31.92 6.73,32.74 4.44,32.74 ; v2(27.43,40.87) 27.43,40.07 U2.76
  Bottom Layer w0.254: v2(27.43,40.87) 27.43,39.35 26.67,38.58 6.6,38.58 5.72,37.69 5.72,33.12 5.33,32.74 H37.3
SWDIO: length 44.9
  Top Layer w0.254: U2.72 30.43,43.21 29.84,43.79 23.5,43.79 22.61,42.9 22.61,39.35 22.1,38.84 14.73,38.84 v2(14.22,39.35) ; 4.44,35.28 6.6,35.28 7.43,36.11 R16.1
  Bottom Layer w0.254: H37.2 3.94,35.16 2.92,35.16 2.41,35.66 2.41,38.58 3.17,39.35 v2(14.22,39.35)
TFT-BLK: length 39.3
  Top Layer w0.254: ST7735.1 53.09,23.34 53.72,23.98 53.72,42.65 53.09,43.28 44.83,43.28 44.32,42.78 v2(44.32,41.63) ; v2(45.21,38.71) 44.91,39.01 U2.48
  Bottom Layer w0.254: v2(44.32,41.63) 44.32,39.09 44.7,38.71 v2(45.21,38.71)
TFT-CS: length 32.3
  Top Layer w0.254: ST7735.2 52.45,25.88 53.09,26.52 53.09,42.39 52.71,42.78 46.1,42.78 45.59,42.27 45.59,41.25 45.34,41 43.43,41 42.87,41.56 U2.51
TFT-DC: length 25.5
  Top Layer w0.254: v2(30.73,30.71) 30.04,30.01 U2.96 ; v2(45.47,30.33) 46.74,30.33 48.64,28.42 ST7735.3
  Bottom Layer w0.254: v2(45.47,30.33) 37.72,30.33 36.32,31.73 31.75,31.73 v2(30.73,30.71)
TFT-RST: length 33
  Top Layer w0.254: v2(35.69,33.95) 35.61,34.02 35.61,38.13 36.96,39.47 39.5,39.47 39.93,39.9 U2.53 ; v2(45.21,35.66) 46.23,36.68 48.01,36.68 48.39,36.3 48.39,31.47 48.9,30.96 ST7735.4
  Bottom Layer w0.254: v2(35.69,33.95) 44.51,33.95 45.21,34.65 v2(45.21,35.66)
TFT-SCL: length 27.5
  Top Layer w0.254: U2.52 40.43,39.64 39.62,38.84 37.08,38.84 36.58,38.33 36.58,37.19 v2(36.19,36.81) ; ST7735.6 50.67,35.92 49.91,35.92 49.4,36.42 49.4,37.31 49.02,37.69 v2(45.21,37.69)
  Bottom Layer w0.254: v2(45.21,37.69) 44.07,36.55 44.07,35.28 43.69,34.9 36.58,34.9 36.19,35.28 v2(36.19,36.81)
TFT-SDA: length 31.1
  Top Layer w0.254: v2(45.21,36.68) 45.72,37.19 48.5,37.19 48.9,36.79 48.9,34.01 49.53,33.38 50.67,33.38 ST7735.5 ; v2(34.93,35.28) 34.93,38.58 36.32,39.98 39.24,39.98 39.43,40.16 U2.54
  Bottom Layer w0.254: v2(45.21,36.68) 44.58,36.04 44.58,35.03 43.94,34.39 36.32,34.39 35.43,35.28 v2(34.93,35.28)
U-PA2: length 68.3
  Top Layer w0.254: v2(13.46,47.22) 12.7,47.22 11.43,45.95 v2(11.43,32.23) ; U2.25 40.93,25.6 41.28,25.25 43.69,25.25 44.58,26.14 44.58,30.84 44.96,31.22 v2(45.47,31.22)
  Bottom Layer w0.254: 19.75,45.97 18.5,47.22 v2(13.46,47.22) ; v2(11.43,32.23) 40.13,32.23 41.15,31.22 v2(45.47,31.22)
U-PA3: length 56.5
  Top Layer w0.254: v2(13.46,45.95) 12.45,45.95 12.06,45.57 v2(12.06,33.25) ; v2(45.47,32.11) 44.58,32.11 43.94,31.47 43.94,28.39 43.56,28.01 U2.26
  Bottom Layer w0.254: 15.68,45.97 15.66,45.95 v2(13.46,45.95) ; v2(45.47,32.11) 41.4,32.11 40.77,32.74 12.57,32.74 v2(12.06,33.25)
U-PA9: length 19.6
  Top Layer w0.254: H24.1 19.77,40.87 21.08,40.87 21.34,41.12 21.34,44.43 21.97,45.06 32,45.06 32.43,44.64 U2.68
U-PA10: length 24.8
  Top Layer w0.254: H25.1 15.62,40.83 15.62,39.6 15.88,39.35 21.46,39.35 21.97,39.85 21.97,43.79 22.61,44.43 31.62,44.43 31.93,44.12 U2.69
VCAP_1: length 4.3
  Top Layer w0.254: 46.77,39.49 46.75,39.51 U2.49
VCAP_2: length 8.7
  Top Layer w0.254: C15.1 24.26,41.37 24.26,42.78 24.64,43.16 29.59,43.16 29.93,42.82 U2.73
VREF+: length 10.6
  Top Layer w0.254: U2.21 38.93,23.03 39.5,22.45 45.69,22.45 R6.2
$1N4149: length 4.6
  Top Layer w0.508: D1.2 63.51,41.46 B1.2
$1N4157: length 41.6
  Top Layer w0.508: C12.2 C13.2 67.56,48.89 67.56,50.39 66.94,51.02 D1.1 63.5,51.03 61.72,51.03 61.09,51.67 61.09,54.33 60.32,55.09 40.39,55.09 39.5,55.98 39.5,58.78 39.35,58.93 SW3.2
$1N4377: length 5.7
  Top Layer w0.254: R9.1 11.89,59.41 10.29,59.41 9.55,60.15 USB2.A5
$1N4405: length 5.4
  Top Layer w0.254: R10.1 11.89,57.15 USB2.B5
$1N4661: length 10
  Top Layer w0.254: U3.7 13.33,51.03 13.72,51.41 13.72,53.06 14.1,53.44 18.54,53.44 18.97,53.02 R11.1
$1N4738: length 5.5
  Top Layer w0.254: U3.6 13.59,49.76 14.35,50.52 14.35,51.79 14.66,52.1 15.67,52.1 R12.1
$1N5807: length 2.8
  Top Layer w0.355: LED2.2 22.11,52.4 R14.1
$1N5874: length 19.3
  Top Layer w0.406: C17.2 C18.2 18.87,57.21 18.87,59.66 20.64,61.43 VTG0.3 BAT0.3
$1N6809: length 3.2
  Top Layer w0.254: LED3.2 57.59,34.79 R17.1
$1N6943: length 3.2
  Top Layer w0.254: LED4.2 67.96,34.79 R18.1
$1N7074: length 3.2
  Top Layer w0.254: R19.1 62.78,34.79 LED6.2

## Copper pours and planes (outline as drawn; the poured copper is in the pictures)
GND on Top Layer: -1.65,66.02 87.63,66.02 87.63,-0.79 -1.65,-0.79
GND on Bottom Layer: -0.64,65.89 86.49,65.89 86.49,-1.17 -0.64,-1.17

Small or netless copper shapes (teardrops, artwork), in the pictures only: 377 on Top Layer, 162 on Bottom Layer

## Text on the board
Bottom Silkscreen Layer: +3.3V | GND | PA4 | PA5 | PA6 | PA7 | PB6 | PA8 | PC7 | PC6 | PC5 | PC4 | PC3 | PC2 | PC1 | PC0 | PB5 | PB7
Top Silkscreen Layer: GND | +3.3V | PB13 | PB15 | PB14 | PB9 | PB12 | PB11 | PE5 | PE4 | PE3 | PE2 | PE1 | PE0 | PD0 | PA3 | TX | PA10 | PA2 | RX | PA9 | 3V3 | CLK | CH-ON | DIO | VCC | 3.3V | STM32F407VE | QinYuYQY
